# EasyEDA Pro project cubicat_pcb.eprj, board PCB_audio_sdcard_lcd
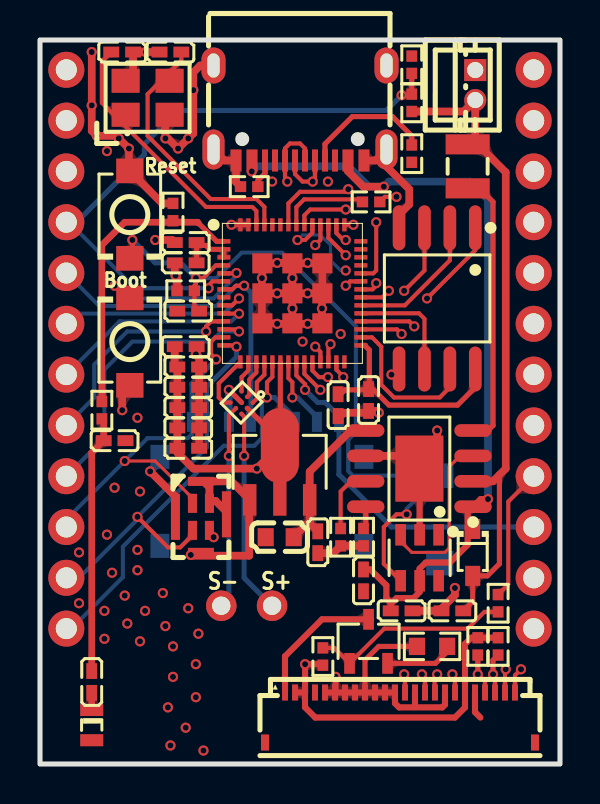
[diagram p9: board, top side]
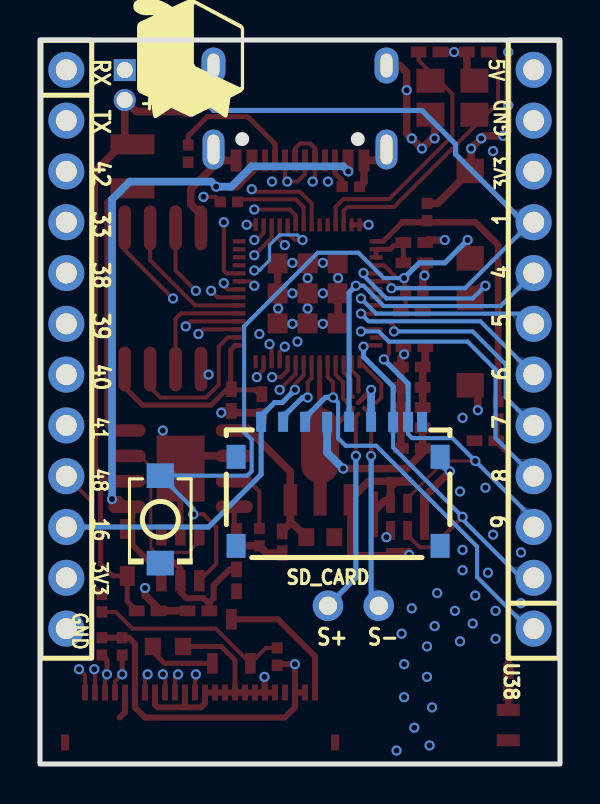
[diagram p10: board, bottom side, seen from below]

Outline 26 x 36.2 mm; copper layers: Top Layer, GND, PWR, Bottom Layer. Coordinates in mm from the lower left corner of the outline.
Outline path: rectangle 0,36.2 26,0
Stack: Top Layer 0.035mm 外层铜厚1oz / Dielectric1 0.2104mm 7628 RC49% 8.6mil / GND 0.0152mm 内层铜厚 / Dielectric2 1.065mm 1.1mm H/HOZ 含铜 / PWR 0.0152mm 内层铜厚 / Dielectric3 0.2104mm 7628 RC49% 8.6mil / Bottom Layer 0.035mm 外层铜厚1oz

## Design rules (mm)
net D-: USB-OTG
net D+: USB-OTG
template: 自定义配置
spacing copperThickness1oz (default): track to track 0.102, other pairs 0.152 to 0.3
spacing copperThickness2oz: track to track 0.203, other pairs 0.152 to 0.3
track width copperThickness1oz (default): min 0.127, default 0.254, max 2.54
track width copperThickness2oz: min 0.203, default 0.254, max 2.54
differential pair 90ohm (default): width min 0.203, default 0.203, max 0.229; gap min 0.152, default 0.203
via viaSize (default): diameter min 0.5, default 0.508, max 10; hole min 0.3, default 0.305, max 6.299

## Placement (name value [footprint] x y rotation side)
ANT1  KH-1608-H08  [ANT-SMD_L1.7-W0.9]  2.59 1.94 90 top
BAT1  A1501WV-2P  [CONN-TH_A1501WV-2P]  21.76 33.95 270 top
Boot  TS-1088-AR02016  [SW-SMD_L3.9-W3.0-P4.45]  4.49 21.12 90 top
C9  10uF  [C0402]  13.89 11.09 270 top
C13  10uF  [C0402]  7.41 16.8 180 top
C14  100nF  [C0402]  7.41 15.79 180 top
C15  1uF  [C0402]  7.41 22.64 0 top
C16  10uF  [C0402]  7.41 18.83 180 top
C17  1uF  [C0402]  7.28 20.87 180 top
C18  100nF  [C0402]  7.28 26.07 0 top
C20  15pF  [C0402]  4.11 35.6 0 top
C21  15pF  [C0402]  6.52 35.6 0 top
C22  1uF  [C0402]  7.41 17.82 180 top
C23  100nF  [C0402]  16.43 18.2 90 top
C24  1uF  [C0402]  14.91 17.95 90 top
C25  1.5pF  [C0402]  3.73 16.17 180 top
C30  10uF  [C0402]  7.41 19.85 180 top
C39  22uF  [C0603]  11.98 11.34 0 top
C40  100nF  [C0402]  16.18 9.18 90 top
C41  10uF  [C0402]  20.62 7.66 180 top
C42  10uF  [C0402]  18.08 7.66 0 top
D1  1N5819WS  [SOD-323_L1.8-W1.3-LS2.5-RD]  21.64 10.58 270 top
ESP32S3R8  -  [esp32s3R8]  12.62 23.53 0 top
FPC1  HC-FPC-05-09-24RLTAG  [FPC-SMD_24P-P0.50_HC-FPC-05-09-24RLTAG]  18 2.32 180 top
L1  2.2uH  [IND-SMD_L2.5-W2.0_MHCHL2520]  21.38 29.88 270 top
L2  2nH  [L0402]  7.28 25.06 0 top
L3  5.6nH  [L0402]  2.59 4.1 90 top
MIC1  LMD4030T261-OA1  [MIC-SMD_8P-L4.0-W3.0]  8.05 12.36 0 top
NOREF  -  [Pad_e32]  9.06 7.91 0 top
NOREF#2  -  [Pad_e34]  11.6 7.91 0 top
on/off1  TS-1088-AR02016  [SW-SMD_L3.9-W3.0-P4.45]  19.99 12.23 270 bottom
Q1  AMS1117-3.3  [SOT-89_L4.5-W2.5-P1.50-LS4.2-BR]  11.98 14.56 270 top
Q2  S8050 J3Y  [SOT-23-3_L3.0-W1.7-P0.95-LS2.9-BR]  16.43 6.13 270 top
R4  10kΩ  [R0402]  14.14 5.37 90 top
R7  10kΩ  [R0402]  7.28 23.66 180 top
R9  5.1kΩ  [R0402]  10.46 28.87 0 top
R10  5.1kΩ  [R0402]  18.59 30.52 270 top
R12  10kΩ  [R0402]  15.03 11.34 270 top
R13  2kΩ  [R0402]  16.18 11.34 270 top
R14  0Ω  [R0402]  3.09 17.69 90 top
R15  0Ω  [R0402]  6.65 27.6 270 top
R20  51kΩ  [R0402]  18.59 33.06 270 top
R22  470Ω  [R0402]  16.56 28.11 0 top
R23  1kΩ  [R0402]  22.91 8.04 270 top
R24  5.1kΩ  [R0402]  22.91 5.88 90 top
R25  5.1kΩ  [R0402]  21.89 5.88 90 top
R27  2Ω  [R0603]  19.6 5.88 0 top
R28  15kΩ  [R0402]  18.59 34.96 270 top
Reset  TS-1088-AR02016  [SW-SMD_L3.9-W3.0-P4.45]  4.49 27.47 270 top
SD_CARD  TF-018  [TF-SMD_TF-018]  11.09 14.01 0 bottom
U25  MAX98357AEWL+T  [WLP-9_L1.4-W1.3-P0.40-R3-C3-BR]  10.08 18.07 45 top
U26  -  [HK015T]  18.97 10.33 180 top
U27  ETA9640E8A  [ESOP-8_L4.9-W3.9-P1.27-LS6.0-BL-EP-1]  18.97 14.77 90 top
U32  W25Q128JVSIQ  [SOIC-8_L5.3-W5.3-P1.27-LS8.0-BL]  19.86 23.28 180 top
U34  PM254-1-12-Z-8.5  [HDR-TH_12P-P2.54-V-F]  24.68 20.74 270 bottom
U38  PM254-1-12-Z-8.5  [HDR-TH_12P-P2.54-V-F]  1.32 20.74 90 bottom
USB1  TYPE-C 16PIN 2MD(073)  [USB-C-SMD_TYPE-C-6PIN-2MD-073]  13 32.55 180 top
X1  40MHz  [osc-smd_4p-l3.2-w2.5-bl_sit8008bi]  5.38 33.31 0 top

## Footprints (pads in the part's own frame, mm; a bottom-side part is the same pattern mirrored in y, then rotated)
ANT-SMD_L1.7-W0.9
  rect 0.6x1.15 smd: 1(-0.756,0) 2(0.756,0)
C0402
  rect 0.79x0.54 smd: 1(-0.545,0) 2(0.545,0)
C0603
  rect 0.8x0.9 smd: 1(-0.7,0) 2(0.7,0)
CONN-TH_A1501WV-2P
  rect 1.1x1.1 hole 0.8: 1(-0.75,0)
  round 1.1 hole 0.8: 2(0.75,0)
ESOP-8_L4.9-W3.9-P1.27-LS6.0-BL-EP-1
  oval 0.63x1.865 smd: 1(-1.905,-2.683) 2(-0.635,-2.683) 3(0.635,-2.683) 4(1.905,-2.683) 5(1.905,2.683) 6(0.635,2.683) 7(-0.635,2.683) 8(-1.905,2.683)
  rect 3.3x2.4 smd: 9(0,0)
esp32s3R8
  rect 0.65x0.22 smd: 1(-3.425,2.6) 2(-3.425,2.2) 3(-3.425,1.8) 4(-3.425,1.4) 5(-3.425,1) 6(-3.425,0.6) 7(-3.425,0.2) 8(-3.425,-0.2) 9(-3.425,-0.6) 10(-3.425,-1) 11(-3.425,-1.4) 12(-3.425,-1.8) 13(-3.425,-2.2) 14(-3.425,-2.6) 29(3.425,-2.6) 30(3.425,-2.2) 31(3.425,-1.8) 32(3.425,-1.4) 33(3.425,-1) 34(3.425,-0.6) 35(3.425,-0.2) 36(3.425,0.2) 37(3.425,0.6) 38(3.425,1) 39(3.425,1.4) 40(3.425,1.8) 41(3.425,2.2) 42(3.425,2.6)
  rect 0.22x0.65 smd: 15(-2.6,-3.425) 16(-2.2,-3.425) 17(-1.8,-3.425) 18(-1.4,-3.425) 19(-1,-3.425) 20(-0.6,-3.425) 21(-0.2,-3.425) 22(0.2,-3.425) 23(0.6,-3.425) 24(1,-3.425) 25(1.4,-3.425) 26(1.8,-3.425) 27(2.2,-3.425) 28(2.6,-3.425) 43(2.6,3.425) 44(2.2,3.425) 45(1.8,3.425) 46(1.4,3.425) 47(1,3.425) 48(0.6,3.425) 49(0.2,3.425) 50(-0.2,3.425) 51(-0.6,3.425) 52(-1,3.425) 53(-1.4,3.425) 54(-1.8,3.425) 55(-2.2,3.425) 56(-2.6,3.425)
  rect 1x1 smd: 57(-1.5,1.5) 57(-1.5,0) 57(-1.5,-1.5) 57(0,1.5) 57(0,0) 57(0,-1.5) 57(1.5,1.5) 57(1.5,0) 57(1.5,-1.5)
FPC-SMD_24P-P0.50_HC-FPC-05-09-24RLTAG
  rect 0.3x0.8 smd: 1(5.75,-1.25) 2(5.25,-1.25) 3(4.75,-1.25) 4(4.25,-1.25) 5(3.75,-1.25) 6(3.25,-1.25) 7(2.75,-1.25) 8(2.25,-1.25) 9(1.75,-1.25) 10(1.25,-1.25) 11(0.75,-1.25) 12(0.25,-1.25) 13(-0.25,-1.25) 14(-0.75,-1.25) 15(-1.25,-1.25) 16(-1.75,-1.25) 17(-2.25,-1.25) 18(-2.75,-1.25) 19(-3.25,-1.25) 20(-3.75,-1.25) 21(-4.25,-1.25) 22(-4.75,-1.25) 23(-5.25,-1.25) 24(-5.75,-1.25)
  rect 0.4x0.8 smd: 25(-6.75,1.25) 26(6.75,1.25)
HDR-TH_12P-P2.54-V-F
  round 1.8 hole 1.05: 1(-13.97,0) 2(-11.43,0) 3(-8.89,0) 4(-6.35,0) 5(-3.81,0) 6(-1.27,0) 7(1.27,0) 8(3.81,0) 9(6.35,0) 10(8.89,0) 11(11.43,0) 12(13.97,0)
HK015T
  rect 0.532x1.072 smd: 1(-0.963,-1.137) 2(-0.013,-1.137) 3(0.938,-1.137) 4(0.938,1.162) 5(-0.013,1.162) 6(-0.963,1.162)
IND-SMD_L2.5-W2.0_MHCHL2520
  rect 1x2.2 smd: 1(-1.1,0) 2(1.1,0)
L0402
  rect 0.79x0.54 smd: 1(-0.545,0) 2(0.545,0)
MIC-SMD_8P-L4.0-W3.0
  rect 0.45x0.95 smd: 1(-0.425,0.675) 2(-0.425,-0.675) 3(0.425,-0.675) 4(0.425,0.675)
  rect 0.45x2.3 smd: 5(1.275,0.127) 7(-1.275,0)
  rect 1.3x0.45 smd: 6(0,-1.775) 8(0,1.775)
osc-smd_4p-l3.2-w2.5-bl_sit8008bi
  rect 1.4x1.2 smd: 1(-1.1,-0.85) 2(1.1,-0.85) 3(1.1,0.85) 4(-1.1,0.85)
Pad_e32
  round 1.524 hole 0.914: 1(0,0)
Pad_e34
  round 1.524 hole 0.914: 2(0,0)
R0402
  rect 0.566x0.54 smd: 1(-0.433,0) 2(0.433,0)
R0603
  rect 0.806x0.864 smd: 1(-0.753,0) 2(0.753,0)
SOD-323_L1.8-W1.3-LS2.5-RD
  rect 1x0.75 smd: 1(-1.173,0) 2(1.173,0)
SOIC-8_L5.3-W5.3-P1.27-LS8.0-BL
  oval 0.63x2.25 smd: 1(-1.905,-3.53) 2(-0.635,-3.53) 3(0.635,-3.53) 4(1.905,-3.53) 5(1.905,3.53) 6(0.635,3.53) 7(-0.635,3.53) 8(-1.905,3.53)
SOT-23-3_L3.0-W1.7-P0.95-LS2.9-BR
  rect 1.038x0.532 smd: 1(1.101,-0.95) 2(1.101,0.95) 3(-1.101,0)
SOT-89_L4.5-W2.5-P1.50-LS4.2-BR
  rect 1.575x0.672 smd: 1(1.356,-1.5) 3(1.356,1.5)
  custom 5.377x1.9 smd: 2(-1.356,0.009)
SW-SMD_L3.9-W3.0-P4.45
  rect 1.23x1.36 smd: 1(-2.185,0) 2(2.185,0)
TF-SMD_TF-018
  rect 0.5x1 smd: 1(3.85,-3.1) 2(2.75,-3.1) 3(1.65,-3.1) 4(0.55,-3.1) 5(-0.55,-3.1) 6(-1.65,-3.1) 7(-2.75,-3.1) 8(-3.5,-3.1) 9(-4.2,-3.1)
  rect 0.95x1.2 smd: 10(-5.1,-1.35) 10(-5.1,3.1) 10(5.1,-1.35) 10(5.1,3.1)
USB-C-SMD_TYPE-C-6PIN-2MD-073
  rect 0.55x1.1 smd: 1(-3.2,2.375) 2(-2.4,2.375) 11(2.4,2.375) 12(3.2,2.375)
  rect 0.3x1.1 smd: 3(-1.75,2.375) 4(-1.25,2.375) 5(-0.75,2.375) 6(-0.25,2.375) 7(0.25,2.375) 8(0.75,2.375) 9(1.25,2.375) 10(1.75,2.375)
  oval 1.1x2 hole 0.6x1.5: 13(-4.325,1.825) 14(4.325,1.825)
  oval 1.2x1.8 hole 0.6x1.2: 13(-4.325,-2.375) 14(4.325,-2.375)
WLP-9_L1.4-W1.3-P0.40-R3-C3-BR
  round 0.23 smd: A1(0.4,-0.4) A2(0,-0.4) A3(-0.4,-0.4) B1(0.4,0) B2(0,0) B3(-0.4,0) C1(0.4,0.4) C2(0,0.4) C3(-0.4,0.4)

## Nets
As in the schematic, except:
VOUT+: NOREF#2.2 U25.A3
VOUT-: NOREF.1 U25.B3

Pads without a net: ESP32S3R8 8 28 39 40 41 42 51 52; FPC1 4; SD_CARD 9; U26 1 6; USB1 3 9

## Via types
v1: diameter 0.508, hole 0.305, Top Layer to Bottom Layer, 124 vias

## Routing (per net, layer and track width the routed paths; a pad name or vN(x,y) marks a point on that pad's centre or on a via; arc(x,y) is an arc through that point)
GND: length 102.3
  Top Layer w0.254: v1(9.44,18.71) U25.B2 ; FPC1.9 16.25,5.19 16.94,5.88 R27.1
  Top Layer w0.305: 22.02,2.32 21.75,2.59 FPC1.20 ; FPC1.14 18.75,2.86 ; FPC1.17 20.25,2.97 20.11,2.83 17.95,2.83 17.75,3.03 FPC1.12 FPC1.11 FPC1.10 FPC1.9 FPC1.8 FPC1.7 FPC1.6 ; U27.9 18.98,14.76 U26.2 ; v1(14.78,4.36) 14.78,3.6 FPC1.6 ; FPC1.6 FPC1.5
  Top Layer w0.381: 16.43,17.56 15.2,17.56 14.91,17.27 ; R9.1 9.8,29.09 USB1.12 9.22,30.17 USB1.14 ; USB1.1 16.78,30.17 USB1.13 17.32,29.88 18.46,28.74 18.46,27.98 17.95,27.47 U32.4 ; v1(5.51,14.63) 6.77,13.37 6.77,12.48 ; ESP32S3R8.57 v1(13.38,23.53) ESP32S3R8.57 ; ESP32S3R8.57 ESP32S3R8.57 13.41,25.03 v1(13.38,25.06) 13.36,25.03 ESP32S3R8.57 ; ESP32S3R8.57 14.09,23.51 v1(14.09,22.78) 14.09,22.01 ; ESP32S3R8.57 v1(12.62,22.77) ESP32S3R8.57 ; ESP32S3R8.57 v1(12.62,24.3) ESP32S3R8.57 ; ESP32S3R8.57 v1(11.86,23.53) 11.09,23.53 ; Boot.1 4.11,18.55 v1(4.11,17.69) ; 9.32,12.61 8.77,13.16 8.47,13.16 8.47,13.83 8.17,14.14 9.57,14.14 10.46,13.25 10.46,10.42 7.58,10.42 v1(7.54,10.45) ; v1(5.76,26.2) 6.61,26.2 C18.1 ; 11.09,23.53 11.09,22.06 ESP32S3R8.57 11.83,22.03 v1(11.86,22.01) v1(13.38,22.01) 14.09,22.01 ; 11.09,23.53 v1(11.09,24.3) 11.12,24.32 ESP32S3R8.57 11.83,25.03 v1(11.86,25.06) 12.59,25.06 ESP32S3R8.57 ; USB1.14 8.01,34.92 7.67,34.58 v1(7.67,33.69) 7.67,31.53 v1(7.41,31.28) v1(6.9,30.77) 6.4,31.28 v1(6.27,31.28) 6.27,32.25 X1.2 ; R15.1 6.11,28.03 4.45,29.69 v1(4.45,30.77) v1(3.94,31.28) 3.81,31.41 v1(2.84,31.41) 2.59,31.66 v1(2.59,32.93) v1(2.59,35.6) ; C23.1 16.85,17.65 v1(16.94,17.56) ; v1(20.75,8.8) 20.75,8.44 20.07,7.77 C41.2 C42.2 ; 14.09,22.01 ESP32S3R8.57 ; R13.2 R12.2 14.67,10.54 C9.2 ; v1(19.86,16.67) 19.86,15.66 U27.9 18.33,15.41 U27.6 ; C17.1 7.83,20.52 v1(7.79,20.48) 7.96,20.32 C30.1 C16.1 C22.1 C13.1 C14.1 ; C21.1 v1(5.29,35.6) C20.2 4.66,34.67 4.18,34.19
  Bottom Layer w0.381: 9.44,18.71 9.44,16.98 ; 6,15.23 6,15.12 v1(5.51,14.63)
  vias: v1(1.95,10.58) v1(1.95,8.04) v1(3.22,7.66) v1(3.22,6.26) v1(3.35,30.64) v1(3.35,11.47) v1(3.6,9.56) v1(3.73,13.81) v1(4.24,8.42) v1(4.36,7.02) v1(4.87,17.31) v1(4.87,10.71) v1(4.87,9.69) v1(5,13.63) v1(5,6.13) v1(5.25,7.66) v1(6.14,8.55) v1(6.27,6.9) v1(6.4,2.83) v1(6.52,0.93) v1(6.65,5.88) v1(6.65,4.36) v1(7.28,1.82) v1(7.41,7.78) v1(7.79,4.99) v1(7.79,3.34) v1(7.92,6.52) v1(8.17,0.67) v1(11.6,29.12) v1(13.13,21.12) v1(14.4,29.12) v1(15.03,21.5)
VBUS_5V: length 54.5
  Top Layer w0.305: 17.53,8 17.83,8.29 18.68,8.29 18.98,8.6 U26.5 18.98,9.77 19.29,10.07 20.49,10.07 21.38,10.96 21.38,12.6 U27.1 22.03,13.25 v1(22.4,13.25) ; 17.53,8 C42.1 ; 17.53,8 17.53,8.08 17.32,8.29 17.32,8.93 16.52,9.73 C40.2
  Top Layer w0.381: v1(17.19,28.87) 16.17,28.87 15.4,29.64 USB1.2 ; USB1.11 10.6,29.64 v1(10.59,29.63)
  PWR w0.381: v1(10.59,29.63) 9.95,28.99 7.54,28.99 1.82,34.71 1.19,34.71
  Bottom Layer w0.381: v1(22.4,13.25) 22.4,28.23 21.51,29.12 17.44,29.12 v1(17.19,28.87) 16.43,28.87 15.41,29.88 10.84,29.88 v1(10.59,29.63)
VCC_3V3: length 45.4
  Top Layer w0.203: v1(13.76,25.95) 14.02,26.2 ESP32S3R8.46
  Top Layer w0.254: v1(9.57,26.96) 10.41,26.96 ESP32S3R8.55 ; 11.98,16.94 11.21,16.94 10.36,17.79 ; ESP32S3R8.20 12.02,16.91
  Top Layer w0.305: FPC1.3 13.25,3.58 v1(13.25,4.99) 14.09,4.99 14.14,4.94 ; FPC1.3 13.25,2.84 13.76,2.32 20.75,2.32 21.25,2.83 FPC1.19 21.25,6 21.56,6.31 22.91,6.31 ; FPC1.3 FPC1.2
  Top Layer w0.381: C17.2 6.74,19.98 C30.2 C16.2 C22.2 C13.2 C14.2 6.87,15.57 7.67,14.77 v1(10.84,14.77) 11.99,15.92 Q1.2 ; 6.85,23.91 6.85,24.35 v1(6.78,24.42) 6.74,24.46 6.74,24.93 ; 8.47,11.81 8.47,11.55 v1(8.68,11.34) ; 11.98,16.94 12.02,16.91
  PWR w0.254: 12.62,22.01 11.09,23.53 13.51,25.95 v1(13.76,25.95)
  Bottom Layer w0.381: v1(10.84,14.77) 11.65,15.57 11.65,16.98
VCC_5V: length 9
  Top Layer w0.381: C9.1 13.48,12.04 13.48,13.2 ; 13.48,13.2 13.48,12.14 C39.2 ; 13.48,13.2 13.48,14.62 15.54,16.67 U27.5
VDD_SPI: length 11
  Top Layer w0.254: 16.52,18.71 15.25,18.71 14.91,18.36 ; U32.8 21.76,18.83 20.87,17.95 17.44,17.95 16.47,18.92 16.47,20.7 16.24,20.93 ESP32S3R8.29
BAT: length 32.3
  Top Layer w0.254: C41.1 21.64,8.13 D1.2 22.37,9.41 22.97,10.01 22.97,14.45
  Top Layer w0.381: 21.65,14.14 22.65,14.14 23.29,14.77 23.29,29.59 21.76,31.11 BAT1.2 21.19,32.62 R20.2
BOOT: length 8.6
  Top Layer w0.203: v1(9.82,24.55) 9.7,24.55 9.68,24.53 ESP32S3R8.5
  Top Layer w0.381: v1(3.73,23.91) 3.88,23.91 Boot.2
  Bottom Layer w0.203: v1(9.82,24.55) 9.82,24.42 8.68,23.28 4.36,23.28 v1(3.73,23.91)
D+: length 15
  Top Layer w0.203: v1(12.37,29.12) 12.25,29.24 USB1.8 12.25,30.78 12.49,31.03 13,31.03 13.25,30.77 13.25,30.18 USB1.6 ; ESP32S3R8.26 14.42,20.89 v1(14.52,20.99)
  PWR w0.203: v1(14.52,20.99) 15.29,20.99 15.54,21.25 15.54,22.33 14.38,23.49 14.38,27.56 12.82,29.12 v1(12.37,29.12)
D-: length 15.3
  Top Layer w0.203: ESP32S3R8.25 14.02,20.61 v1(13.76,20.87) ; USB1.5 13.75,29.24 v1(13.63,29.12) 13.13,29.12 12.75,29.5 USB1.7
  PWR w0.203: v1(13.63,29.12) 13.63,28.87 14.78,27.72 14.78,23.66 15.92,22.52 15.92,20.99 15.41,20.48 14.14,20.48 v1(13.76,20.87)
DAC_BCK: length 1.6
  Top Layer w0.203: ESP32S3R8.16 10.42,19.68 10.08,19.34 U25.C1
DAC_DIN: length 1.9
  Top Layer w0.203: ESP32S3R8.17 10.82,19.57 10.46,19.22 10.46,18.46 U25.B1
DAC_SD_MODE: length 2.3
  Top Layer w0.203: U25.A1 10.84,18.27 10.84,19.09 11.22,19.47 ESP32S3R8.18
DAC_WS: length 2.9
  Top Layer w0.203: ESP32S3R8.15 8.94,19.03 8.94,18.33 9.19,18.07 9.51,18.07
ENABLE: length 8.7
  Top Layer w0.152: U26.3 18.03,11.14 18.59,10.58 20.24,10.58 20.46,10.8 20.46,14.86 21,15.41 21.78,15.41
GPIO1: length 30.9
  Top Layer w0.203: ESP32S3R8.6 8.63,24.13 8.43,23.93 v1(8.43,23.79)
  Top Layer w0.254: v1(18.08,33.44) 18.54,33.44 R20.1 R28.2
  Bottom Layer w0.203: 1.19,27.09 1.44,27.09 4.75,23.79 v1(8.43,23.79)
  Bottom Layer w0.254: U38.9 1.82,27.09 5.22,30.48 5.22,30.99 6.9,32.68 17.32,32.68 v1(18.08,33.44)
GPIO4: length 34.8
  Top Layer w0.203: ESP32S3R8.9 9.61,22.93 v1(9.95,23.28) ; v1(20.62,4.48) 20.75,4.35 FPC1.18
  PWR w0.203: v1(9.95,23.28) 11.09,22.14 11.09,18.83 10.84,18.58 10.84,18.07 13.38,15.53 13.38,11.72 v1(20.62,4.48)
  Bottom Layer w0.203: 1.19,22.01 1.44,22.26 ; U38.7 1.82,22.52 9.19,22.52 v1(9.95,23.28)
GPIO5: length 34.1
  Top Layer w0.203: ESP32S3R8.10 9.21,22.52 v1(9.95,22.52) ; v1(19.86,4.48) 19.73,4.36 19.73,3.59 FPC1.16
  PWR w0.203: v1(9.95,22.52) 10.71,21.76 10.71,19.13 10.33,18.75 10.33,17.82 12.62,15.53 12.62,11.72 v1(19.86,4.48)
  Bottom Layer w0.203: v1(9.95,22.52) 9.57,22.14 3.98,22.14 U38.6
GPIO6: length 33.3
  Top Layer w0.203: v1(8.3,21.63) 8.3,21.88 8.55,22.13 ESP32S3R8.11 ; FPC1.13 18.25,4.19 18.21,4.23 v1(18.21,4.48)
  PWR w0.203: v1(8.3,21.63) 8.3,18.33 11.48,15.15 11.48,11.21 v1(18.21,4.48)
  Bottom Layer w0.203: U38.5 2.71,18.33 2.71,19.98 4.36,21.63 v1(8.3,21.63)
GPIO7: length 36.7
  Top Layer w0.203: v1(19.1,4.48) 19.25,4.33 FPC1.15 ; ESP32S3R8.12 9.85,21.73 v1(9.95,21.63)
  PWR w0.203: v1(19.1,4.48) 12.11,11.47 12.11,15.28 9.95,17.44 9.95,19.09 10.33,19.47 10.33,21.25 v1(9.95,21.63)
  Bottom Layer w0.203: U38.4 3.22,16.29 3.22,19.72 4.62,21.12 8.56,21.12 9.06,21.63 v1(9.95,21.63)
GPIO17: length 21.2
  Top Layer w0.203: v1(14.02,18.71) 13.22,19.5 ESP32S3R8.23 ; FPC1.21 22.25,4.12 v1(21.89,4.48)
  Top Layer w0.254: R25.1 v1(21.89,4.48)
  PWR w0.203: v1(14.02,18.71) 14.02,12.36 v1(21.89,4.48)
GPIO18: length 21.6
  Top Layer w0.203: v1(22.65,4.48) 22.75,4.39 FPC1.22 ; v1(14.4,19.34) 13.95,19.34 13.62,19.67 ESP32S3R8.24
  Top Layer w0.254: R24.1 22.65,5.19 v1(22.65,4.48)
  PWR w0.203: v1(22.65,4.48) 14.65,12.48 14.65,19.09 v1(14.4,19.34)
GPIO21: length 20.1
  Top Layer w0.203: v1(23.29,4.74) 23.25,4.7 FPC1.23 ; ESP32S3R8.27 14.82,19.72 15.16,19.38 v1(15.16,19.34)
  PWR w0.203: v1(23.29,4.74) 15.16,12.87 v1(15.16,19.34)
GPIO33: length 11.1
  Top Layer w0.203: ESP32S3R8.38 16.67,24.53 16.81,24.68 v1(16.81,27.09)
  PWR w0.203: v1(16.81,27.09) U34.4
GPIO38: length 10.5
  Top Layer w0.203: v1(15.67,26.96) 15.22,26.96 ESP32S3R8.43
  PWR w0.203: U34.5 22.65,26.58 16.05,26.58 v1(15.67,26.96)
GPIO39: length 13
  Top Layer w0.203: v1(15.29,26.2) 15.17,26.2 14.82,26.55 ESP32S3R8.44
  PWR w0.203: v1(15.29,26.2) 15.54,25.95 22.27,25.95 23.41,24.8 23.41,23.28 U34.6
GPIO40: length 15.5
  Top Layer w0.203: ESP32S3R8.45 14.42,26.31 v1(15.29,25.44)
  PWR w0.203: U34.7 23.03,21.12 23.03,24.04 21.64,25.44 v1(15.29,25.44)
GPIO41: length 20.5
  Top Layer w0.203: v1(12.87,26.2) 13.25,26.2 13.62,26.56 ESP32S3R8.47
  PWR w0.203: 15.16,24.68 v1(15.29,24.68) 15.54,24.93 21.13,24.93 22.53,23.53 22.53,19.85 24.68,17.69 U34.8
  Bottom Layer w0.152: v1(15.29,24.68) 15.03,24.68 14.52,25.18 14.52,25.95 14.02,26.45 13.13,26.45 v1(12.87,26.2)
GPIO42: length 12.9
  Top Layer w0.203: v1(15.29,27.72) 13.51,27.72 13.22,27.44 ESP32S3R8.48
  PWR w0.203: v1(15.29,27.72) 22.78,27.72 U34.3
GPIO47: length 24.9
  Top Layer w0.203: v1(15.29,23.91) 15.5,24.13 ESP32S3R8.37 ; v1(24.05,4.74) 23.75,4.44 FPC1.24
  PWR w0.203: v1(15.29,23.91) 16.43,22.77 16.43,12.36 v1(24.05,4.74)
GPIO48: length 23.3
  Top Layer w0.203: U34.9 23.41,13.12 23.41,8.98 R23.1 ; ESP32S3R8.36 16.63,23.73 16.81,23.91 v1(16.81,24.04)
  PWR w0.203: U34.9 22.02,17.06 22.02,23.15 20.87,24.3 17.06,24.3 v1(16.81,24.04)
RESET: length 37.5
  Top Layer w0.203: ESP32S3R8.4 8.79,24.93 8.15,24.3 v1(7.79,24.3) 7.79,23.99 7.72,23.91 7.72,22.88 C15.2 ; U26.4 17.19,10 17.19,11.85 17.83,12.48 v1(18.33,12.48)
  Top Layer w0.254: Reset.2 4.62,25.41 v1(4.62,26.2)
  Bottom Layer w0.203: v1(18.33,12.48) 18.33,12.76 on/off1.1 15.64,14.42 15.41,14.64 15.41,16.21 15.79,16.59 15.79,21.88 12.11,25.56 10.08,25.56 8.81,24.3 v1(7.79,24.3)
  Bottom Layer w0.254: v1(4.62,26.2) 5.76,25.06 7.03,25.06 v1(7.79,24.3)
RXD: length 15.9
  Top Layer w0.203: 15.41,28.87 v1(15.41,28.74) 15.29,28.61 13,28.61 12.42,28.03 12.42,27.34
  PWR w0.203: 15.41,28.61 16.18,29.38 19.35,29.38 U34.1
SD_CLK: length 18.2
  Top Layer w0.203: v1(10.21,23.91) 9.79,23.91 9.61,23.73 ESP32S3R8.7
  Bottom Layer w0.203: 1.32,24.68 U38.8 2.97,22.9 8.81,22.9 9.82,23.91 v1(10.21,23.91)
  Bottom Layer w0.254: SD_CARD.5 10.54,23.58 v1(10.21,23.91)
SD_CMD: length 20.8
  Top Layer w0.203: v1(11.35,18.33) 11.35,19.09 11.62,19.36 ESP32S3R8.19
  Bottom Layer w0.203: v1(11.35,18.33) 11.09,18.07 11.09,16.29 10.71,15.91 9.19,15.91 4.14,10.87 4.14,9.34 1.57,6.77 U38.1
  Bottom Layer w0.254: v1(11.35,18.33) 11.73,18.33 12.75,17.31 12.75,16.98
SD_DATA0: length 20.1
  Top Layer w0.203: ESP32S3R8.14 9.76,20.93 v1(9.82,20.87) ; v1(4.87,12.36) 6.4,10.83 7.01,10.83 7.62,11.44 7.62,11.81
  Bottom Layer w0.203: SD_CARD.7 8.34,15.83 v1(4.87,12.36) 4.87,12.23 1.95,9.31 1.32,9.31
  Bottom Layer w0.254: v1(9.82,20.87) 9.82,20.36 8.34,18.88 SD_CARD.7
SD_DATA1: length 18.8
  Top Layer w0.152: v1(4.24,15.15) 5.76,15.15 7.62,13.29 MIC1.1
  Top Layer w0.203: v1(8.81,20.23) 8.56,20.48 8.56,21.12 8.77,21.33 ESP32S3R8.13
  Bottom Layer w0.203: SD_CARD.8 7.59,16.5 7.39,16.29 5.38,16.29 v1(4.24,15.15) 1.32,12.23 U38.3
  Bottom Layer w0.254: v1(8.81,20.23) 7.59,19.02 SD_CARD.8
SD_DATA2: length 17.6
  Top Layer w0.203: v1(13.25,18.71) 13.25,18.99 12.82,19.43 ESP32S3R8.22
  Bottom Layer w0.254: U34.10 17.57,11.85 14.94,14.48 14.94,17.4 14.27,18.07 13.89,18.07 v1(13.25,18.71)
SD_DATA3: length 3.9
  Top Layer w0.203: v1(12.62,18.33) 12.62,19.09 12.42,19.29 ESP32S3R8.21
  Bottom Layer w0.254: v1(12.62,18.33) 12.87,18.33 13.84,17.35 13.84,16.98
SPICLK: length 5.8
  Top Layer w0.203: U32.6 19.22,22.26 18.95,22.54 16.05,22.54 ESP32S3R8.33
SPICS0: length 9
  Top Layer w0.203: v1(18.72,21.88) 18.46,22.13 ESP32S3R8.32 ; U32.1 21.76,25.69 v1(19.35,23.28)
  PWR w0.203: v1(19.35,23.28) 18.72,22.64 v1(18.72,21.88)
SPID: length 6.4
  Top Layer w0.203: 18.08,19.75 17.8,19.47 v1(17.57,19.47) ; ESP32S3R8.35 17.12,23.33 v1(17.44,23.66)
  PWR w0.203: v1(17.44,23.66) 17.57,23.53 v1(17.57,19.47)
SPIHD: length 8
  Top Layer w0.203: ESP32S3R8.30 16.6,21.33 17.06,20.87 17.06,18.96 17.7,18.33 19.99,18.33 20.62,18.96 20.62,19.75
SPIQ: length 7
  Top Layer w0.203: U32.2 20.49,25.18 18.24,22.93 ESP32S3R8.34
SPIWP: length 7.9
  Top Layer w0.203: v1(18.21,23.66) 19.22,24.68 U32.3 ; ESP32S3R8.31 17.85,21.73 v1(18.08,21.5)
  PWR w0.203: v1(18.08,21.5) 18.21,21.63 v1(18.21,23.66)
TXD: length 9.4
  Top Layer w0.203: R22.2 17.24,28.36 v1(17.83,28.36)
  PWR w0.203: U34.2 20.87,28.36 v1(17.83,28.36)
VOUT+: length 10.2
  Top Layer w0.203: v1(10.21,15.41) 10.21,17.38 U25.A3
  Bottom Layer w0.254: NOREF#2.2 10.21,9.31 v1(10.21,15.41)
VOUT-: length 10.2
  Top Layer w0.203: v1(9.44,15.41) 9.44,17.44 9.8,17.79
  Bottom Layer w0.254: NOREF.1 9.44,8.29 v1(9.44,15.41)
$1N4090: length 6.6
  Top Layer w0.254: R10.1 18.59,31.41 17.62,32.37 15.62,32.37 14.25,31.01 USB1.4
$1N4091: length 1.5
  Top Layer w0.254: USB1.10 11.25,29.53 10.89,29.17 R9.2
$1N4114: length 13.1
  Top Layer w0.203: ESP32S3R8.53 11.22,27.85 10.82,28.25 8.54,28.25 5.38,31.41 5.38,33.49 7.07,35.18 C21.2
$1N4115: length 13.4
  Top Layer w0.203: 3.56,35.6 3.09,35.13 3.09,33.06 8.3,27.85 10.62,27.85 10.82,27.65 ESP32S3R8.54
$1N4126: length 2.7
  Top Layer w0.254: L2.2 7.83,25.82 7.94,25.93 8.3,25.93 8.5,25.73 ESP32S3R8.2 ESP32S3R8.3
$1N4130: length 0.9
  Top Layer w0.33: L3.1 ANT1.2
$1N4132: length 12.9
  Top Layer w0.33: R14.1 3.18,17.17 C25.2 2.59,15.57 L3.2
$1N4134: length 14.8
  Top Layer w0.254: 7.92,27.07 7.92,27.05 8.84,26.13 ESP32S3R8.1
  Top Layer w0.33: 7.92,27.05 7.88,27.09 4.24,27.09 3.09,25.95 R14.2
$1N4203: length 4.1
  Top Layer w0.203: 12.82,27.34 12.82,27.84 13.21,28.23 16.25,28.23
$1N60344: length 6.9
  Top Layer w0.305: FPC1.1 12.25,5.38 14.1,7.24 16.56,7.24
$1N60345: length 10.1
  Top Layer w0.203: R23.2 22.22,7.61 21.38,6.77 17.22,6.77 Q2.1 14.71,5.81 R4.2
$1N71273: length 3.5
  Top Layer w0.254: R27.2 20.36,5.62 19.77,5.03 Q2.2
$1N78702: length 1.1
  Top Layer w0.254: U27.8 16.29,11.89 R13.1
$1N78703: length 3.3
  Top Layer w0.203: R12.1 15.03,13.63 15.54,14.14 16.29,14.14
$1N78706: length 13.9
  Top Layer w0.254: L1.2 21.97,28.78 22.65,28.11 22.65,16.93 22.27,16.55 21.65,16.55

## Copper pours and planes (outline as drawn; the poured copper is in the pictures)
GND on Top Layer: -1.22,38.14 28.75,38.14 28.75,-0.85 -1.22,-0.85
GND on Bottom Layer: -2.75,38.65 27.86,38.65 27.86,-3.39 -2.75,-3.39
GND on GND: -3.13,39.15 29.76,39.15 29.76,-5.3 -3.13,-5.3
VCC_3V3 on PWR: -2.49,38.14 27.99,38.14 27.99,-3.39 -2.49,-3.39

Small or netless copper shapes (teardrops, artwork), in the pictures only: 306 on Top Layer, 59 on Bottom Layer, 47 on PWR

## Text on the board
Bottom Silkscreen Layer: 5V | 16 | 41 | 48 | 3V3 | GND | S- | S+ | - | + | RX | TX | 42 | 33 | 38 | 39 | 40 | 1 | 4 | 5 | 6 | 7 | 8 | 9
Top Silkscreen Layer: S- | S+
